# Altium schematic sheet 0218_GPU GDDR6 CHANNELS.SchDoc
size 848 x 558 mm
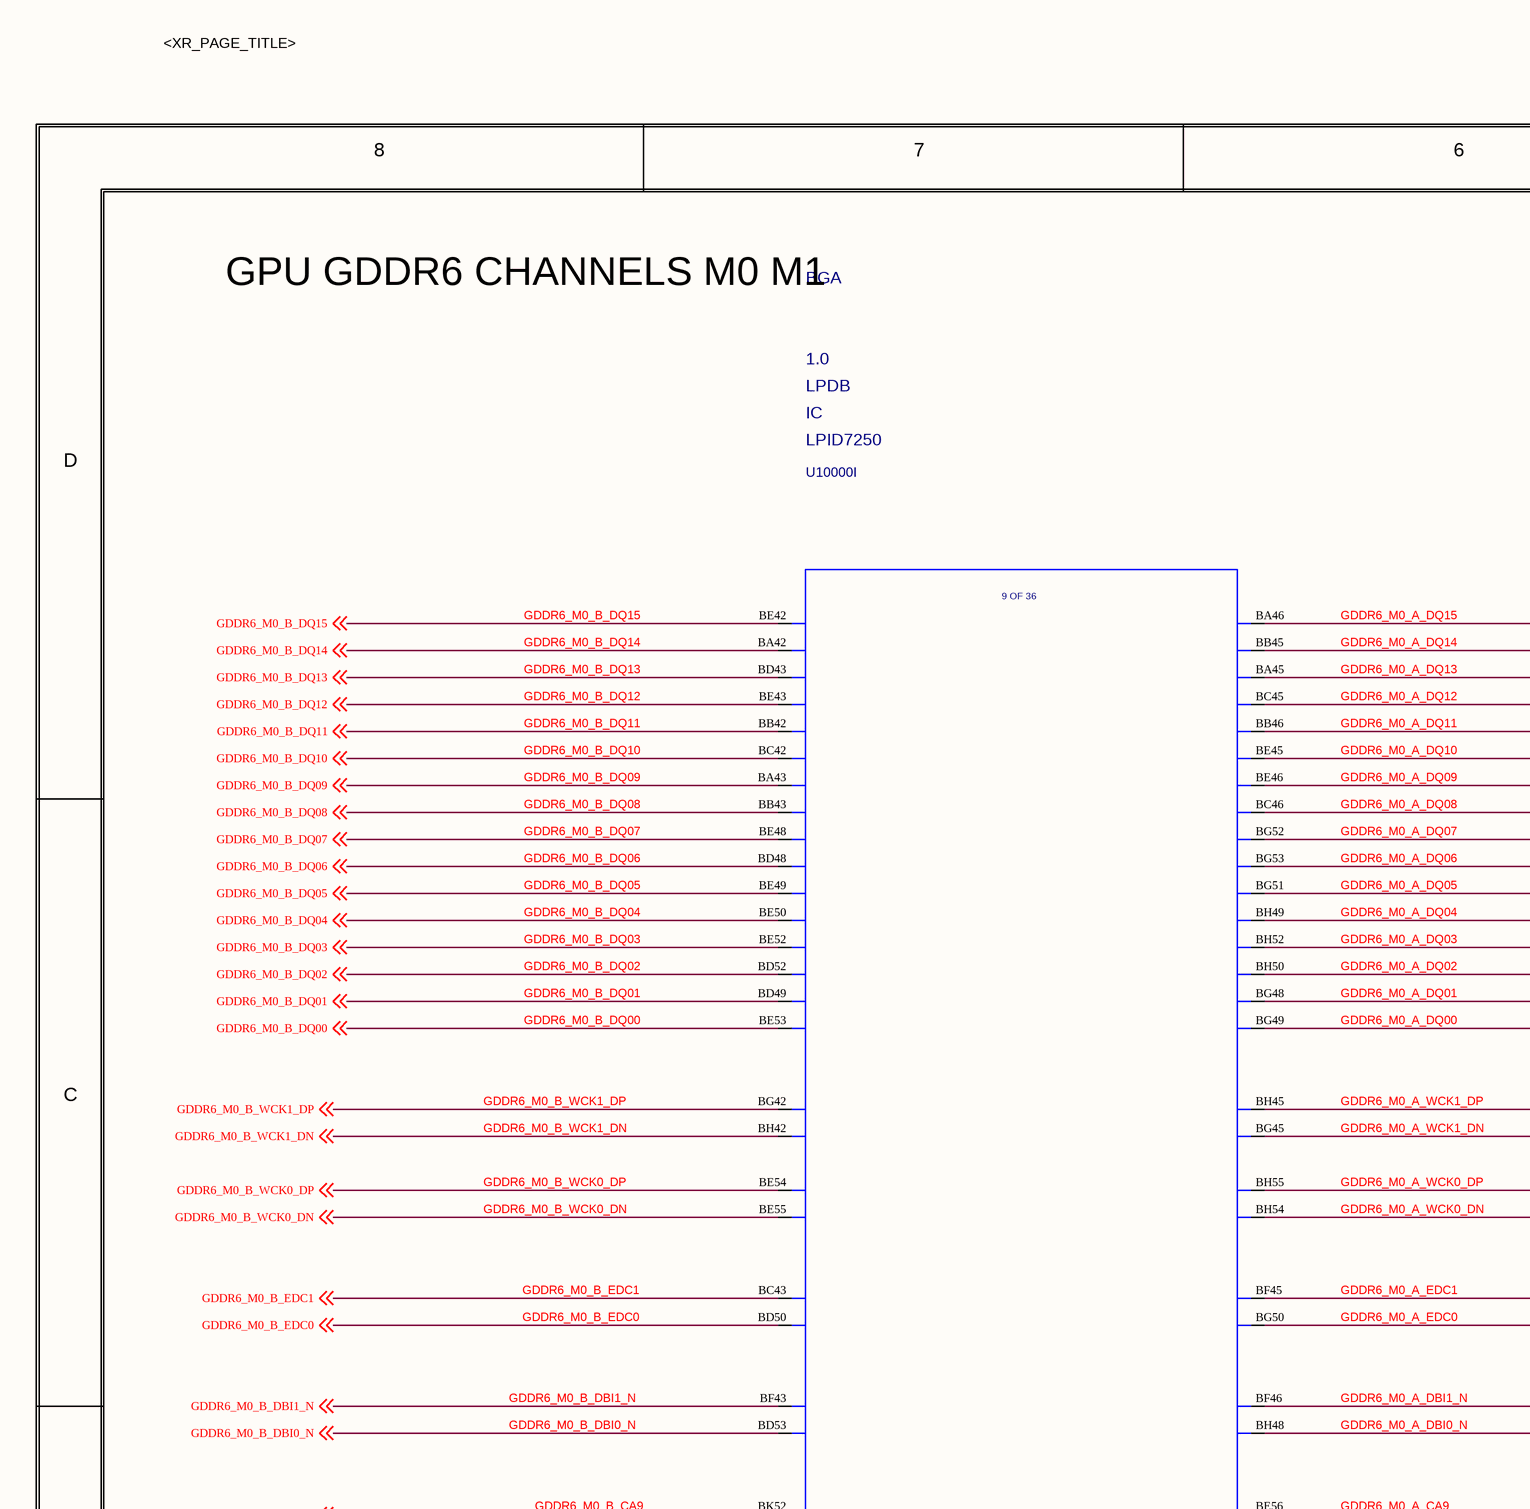
[diagram p0: 0218_GPU GDDR6 CHANNELS.SchDoc, top left]
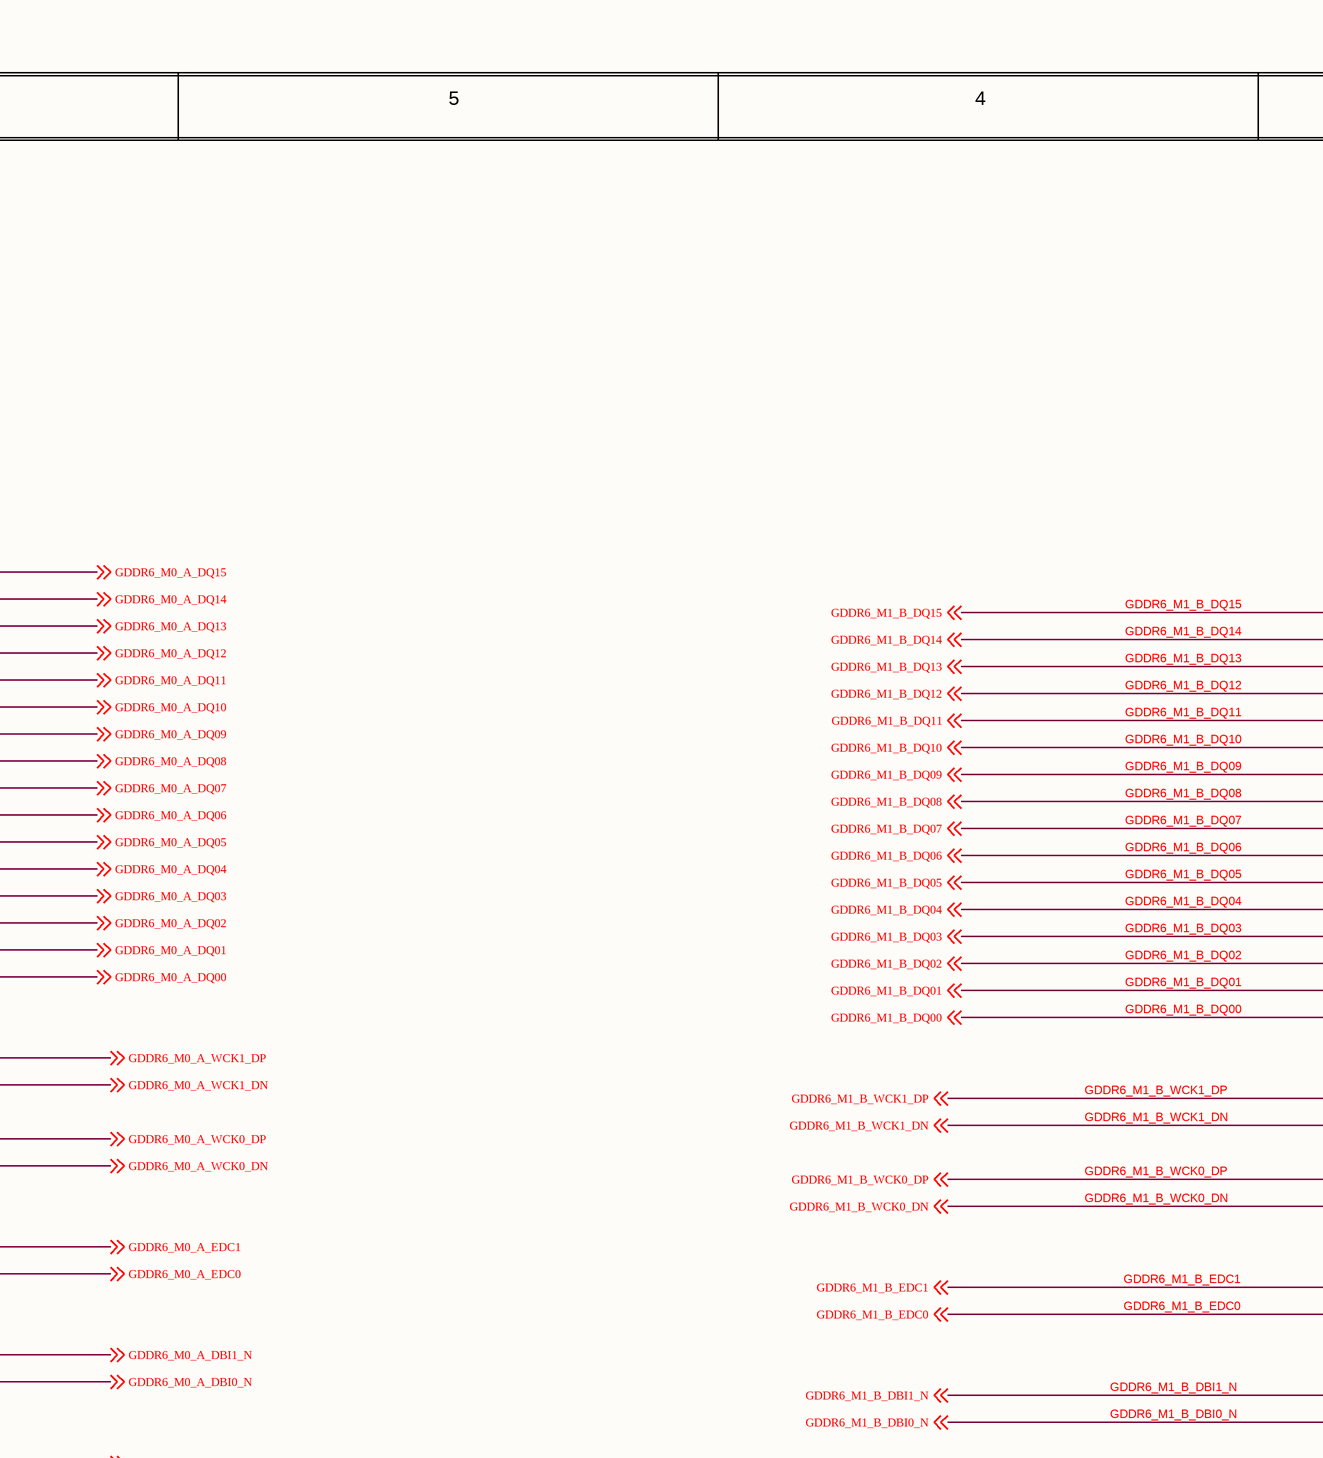
[diagram p1: 0218_GPU GDDR6 CHANNELS.SchDoc, top middle]
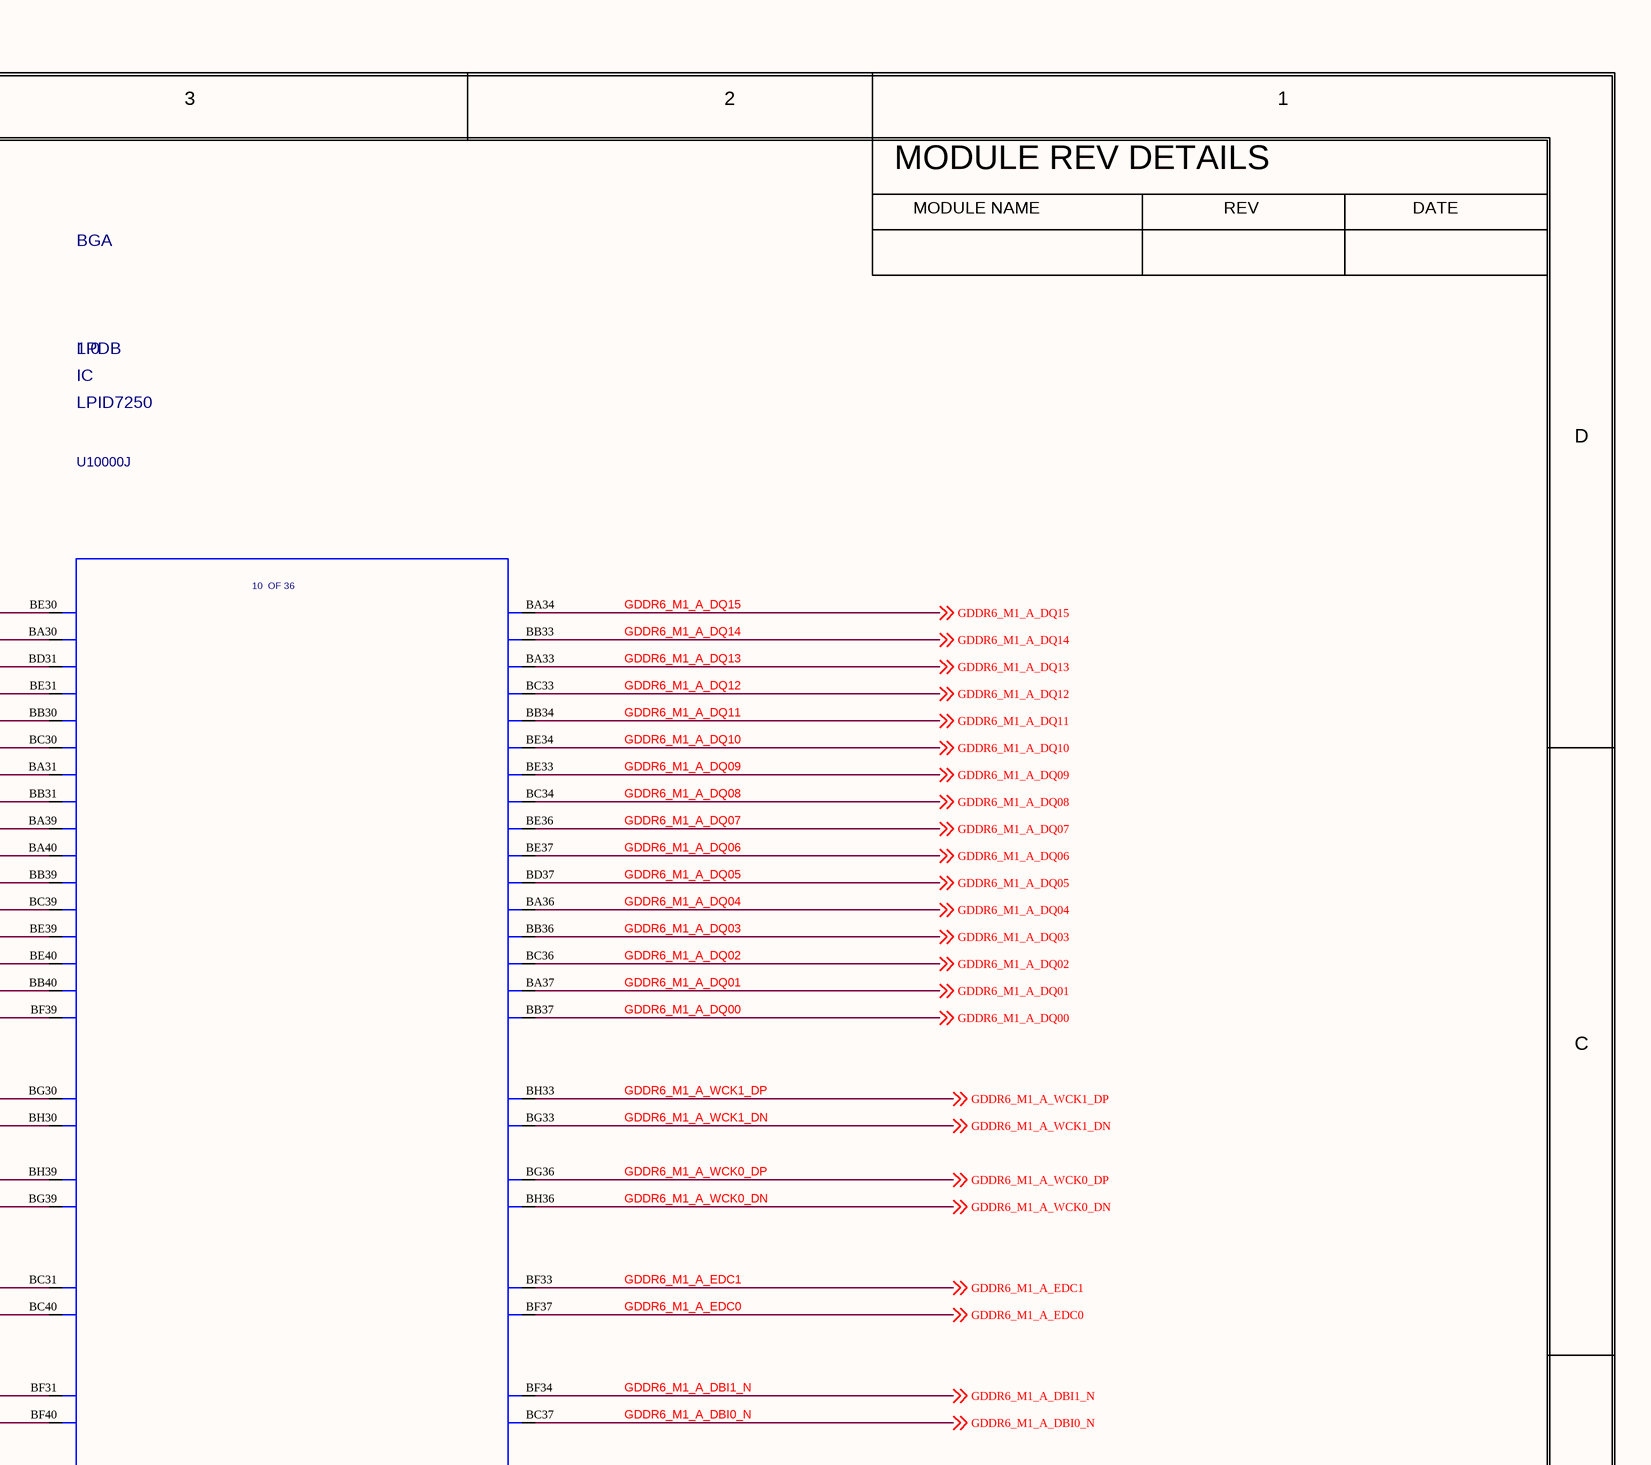
[diagram p2: 0218_GPU GDDR6 CHANNELS.SchDoc, top right]
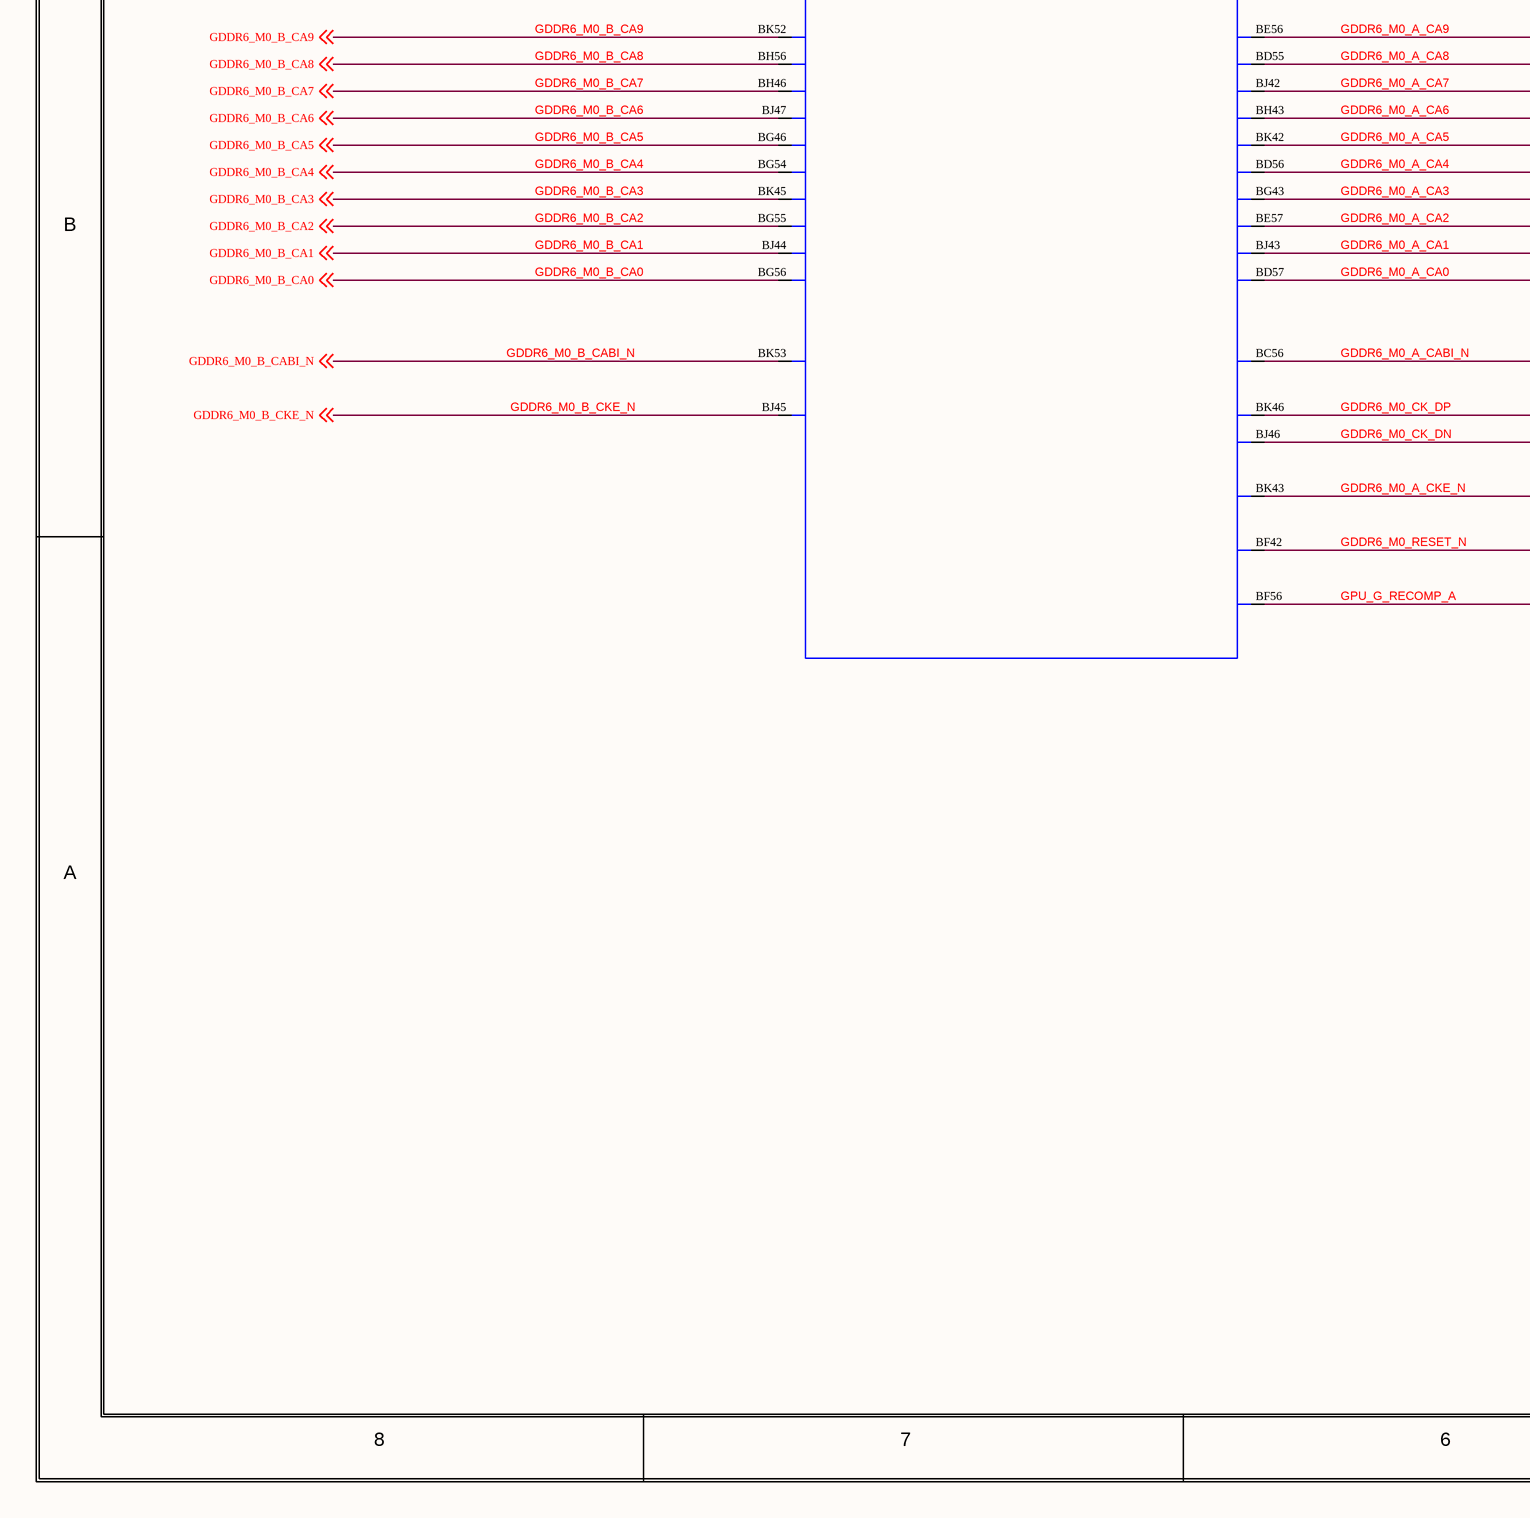
[diagram p3: 0218_GPU GDDR6 CHANNELS.SchDoc, bottom left]
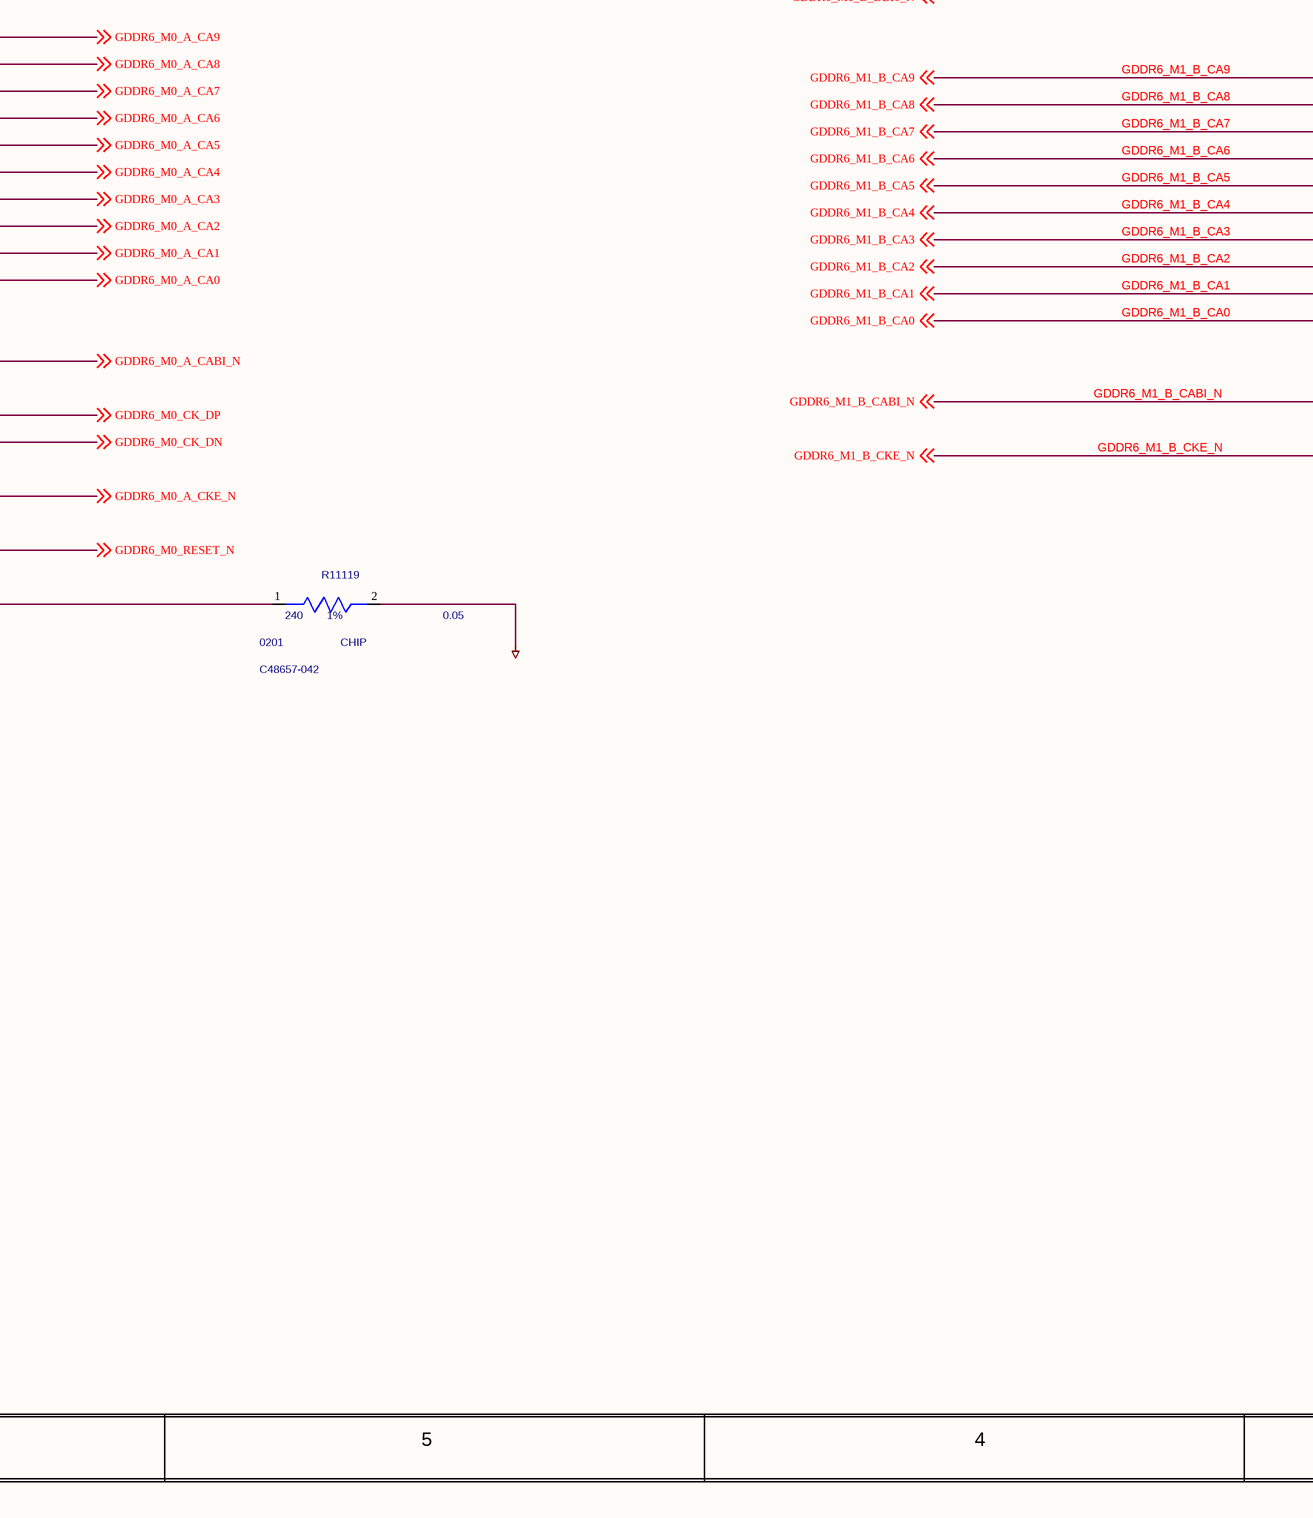
[diagram p4: 0218_GPU GDDR6 CHANNELS.SchDoc, bottom middle]
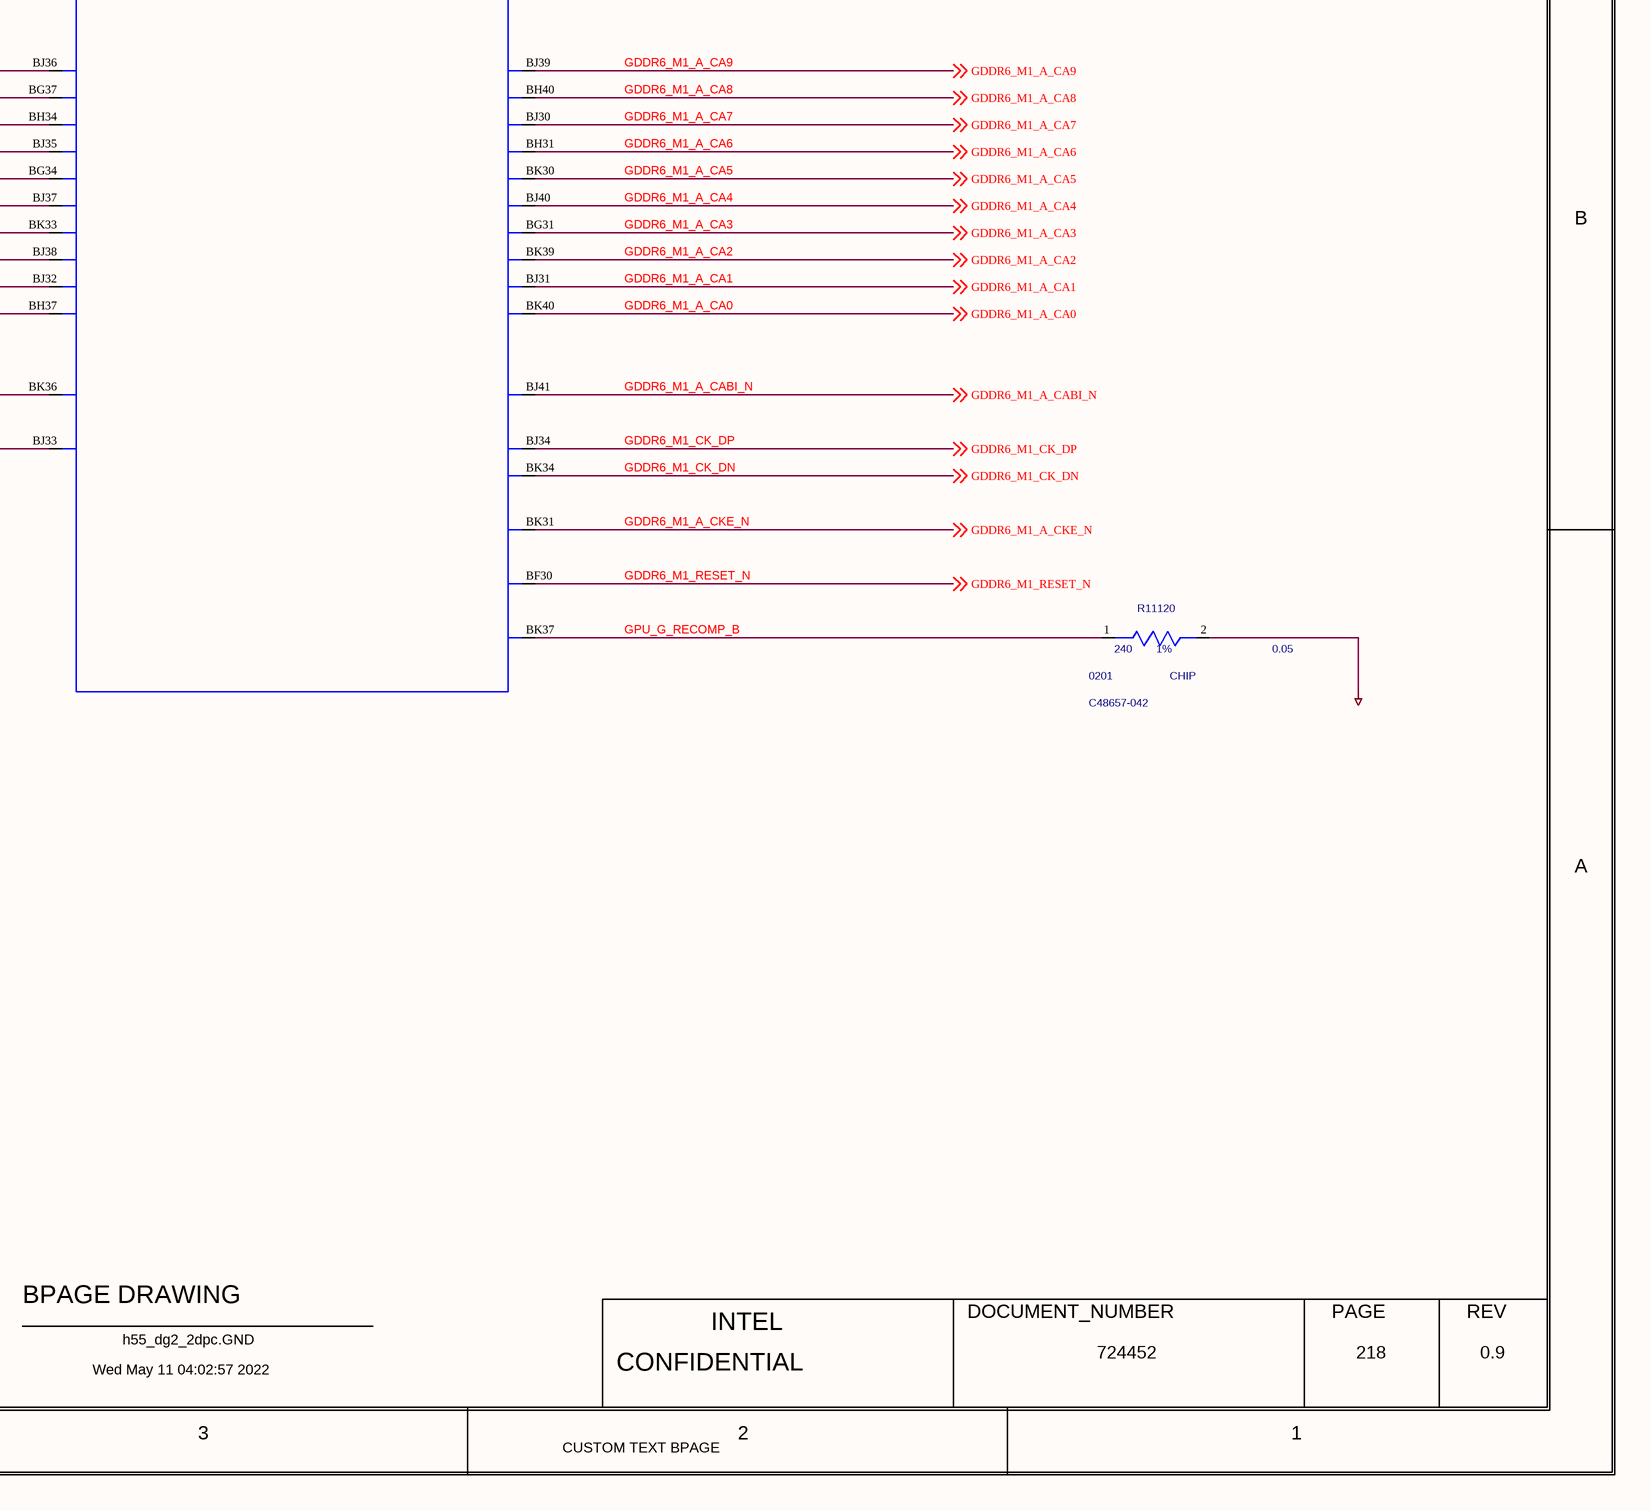
[diagram p5: 0218_GPU GDDR6 CHANNELS.SchDoc, bottom right]

## Parts
R11119  240  MATERIAL: CHIP  PACK_TYPE: 0201  PART_NUMBER: C48657-042  TOLERANCE: 1%  WATTAGE: 0.05  [SMR0201IA]
R11120  240  MATERIAL: CHIP  PACK_TYPE: 0201  PART_NUMBER: C48657-042  TOLERANCE: 1%  WATTAGE: 0.05  [SMR0201IA]
U10000  PART_NUMBER: LPID7250  PACK_TYPE: BGA  MATERIAL: IC  FP_TECH: LPDB  BMAP_REV: 1.0  [CLPDB_BGA2660_DG2_SVC_512_LP7250_MA]  (hidden comment: DG2_IP_NB_SKU1_SKU2_SKU3_EXT)  (parts I,J of 36)

## Nets
GND: R11119.2(B) R11120.2(B)
GDDR6_M0_A_CA0: U10000.BD57(GDDR_C0_A_CA0) ; off-sheet GDDR6_M0_A_CA0
GDDR6_M0_A_CA1: U10000.BJ43(GDDR_C0_A_CA1) ; off-sheet GDDR6_M0_A_CA1
GDDR6_M0_A_CA2: U10000.BE57(GDDR_C0_A_CA2) ; off-sheet GDDR6_M0_A_CA2
GDDR6_M0_A_CA3: U10000.BG43(GDDR_C0_A_CA3) ; off-sheet GDDR6_M0_A_CA3
GDDR6_M0_A_CA4: U10000.BD56(GDDR_C0_A_CA4) ; off-sheet GDDR6_M0_A_CA4
GDDR6_M0_A_CA5: U10000.BK42(GDDR_C0_A_CA5) ; off-sheet GDDR6_M0_A_CA5
GDDR6_M0_A_CA6: U10000.BH43(GDDR_C0_A_CA6) ; off-sheet GDDR6_M0_A_CA6
GDDR6_M0_A_CA7: U10000.BJ42(GDDR_C0_A_CA7) ; off-sheet GDDR6_M0_A_CA7
GDDR6_M0_A_CA8: U10000.BD55(GDDR_C0_A_CA8) ; off-sheet GDDR6_M0_A_CA8
GDDR6_M0_A_CA9: U10000.BE56(GDDR_C0_A_CA9) ; off-sheet GDDR6_M0_A_CA9
GDDR6_M0_A_CABI_N: U10000.BC56(GDDR_C0_A_CABI_N) ; off-sheet GDDR6_M0_A_CABI_N
GDDR6_M0_A_CKE_N: U10000.BK43(GDDR_C0_A_CKE_N) ; off-sheet GDDR6_M0_A_CKE_N
GDDR6_M0_A_DBI0_N: U10000.BH48(GDDR_C0_A_DBI0_N) ; off-sheet GDDR6_M0_A_DBI0_N
GDDR6_M0_A_DBI1_N: U10000.BF46(GDDR_C0_A_DBI1_N) ; off-sheet GDDR6_M0_A_DBI1_N
GDDR6_M0_A_DQ00: U10000.BG49(GDDR_C0_A_DQ0) ; off-sheet GDDR6_M0_A_DQ00
GDDR6_M0_A_DQ01: U10000.BG48(GDDR_C0_A_DQ1) ; off-sheet GDDR6_M0_A_DQ01
GDDR6_M0_A_DQ02: U10000.BH50(GDDR_C0_A_DQ2) ; off-sheet GDDR6_M0_A_DQ02
GDDR6_M0_A_DQ03: U10000.BH52(GDDR_C0_A_DQ3) ; off-sheet GDDR6_M0_A_DQ03
GDDR6_M0_A_DQ04: U10000.BH49(GDDR_C0_A_DQ4) ; off-sheet GDDR6_M0_A_DQ04
GDDR6_M0_A_DQ05: U10000.BG51(GDDR_C0_A_DQ5) ; off-sheet GDDR6_M0_A_DQ05
GDDR6_M0_A_DQ06: U10000.BG53(GDDR_C0_A_DQ6) ; off-sheet GDDR6_M0_A_DQ06
GDDR6_M0_A_DQ07: U10000.BG52(GDDR_C0_A_DQ7) ; off-sheet GDDR6_M0_A_DQ07
GDDR6_M0_A_DQ08: U10000.BC46(GDDR_C0_A_DQ8) ; off-sheet GDDR6_M0_A_DQ08
GDDR6_M0_A_DQ09: U10000.BE46(GDDR_C0_A_DQ9) ; off-sheet GDDR6_M0_A_DQ09
GDDR6_M0_A_DQ10: U10000.BE45(GDDR_C0_A_DQ10) ; off-sheet GDDR6_M0_A_DQ10
GDDR6_M0_A_DQ11: U10000.BB46(GDDR_C0_A_DQ11) ; off-sheet GDDR6_M0_A_DQ11
GDDR6_M0_A_DQ12: U10000.BC45(GDDR_C0_A_DQ12) ; off-sheet GDDR6_M0_A_DQ12
GDDR6_M0_A_DQ13: U10000.BA45(GDDR_C0_A_DQ13) ; off-sheet GDDR6_M0_A_DQ13
GDDR6_M0_A_DQ14: U10000.BB45(GDDR_C0_A_DQ14) ; off-sheet GDDR6_M0_A_DQ14
GDDR6_M0_A_DQ15: U10000.BA46(GDDR_C0_A_DQ15) ; off-sheet GDDR6_M0_A_DQ15
GDDR6_M0_A_EDC0: U10000.BG50(GDDR_C0_A_EDC0) ; off-sheet GDDR6_M0_A_EDC0
GDDR6_M0_A_EDC1: U10000.BF45(GDDR_C0_A_EDC1) ; off-sheet GDDR6_M0_A_EDC1
GDDR6_M0_A_WCK0_DN: U10000.BH54(GDDR_C0_A_WCK0_DN) ; off-sheet GDDR6_M0_A_WCK0_DN
GDDR6_M0_A_WCK0_DP: U10000.BH55(GDDR_C0_A_WCK0_DP) ; off-sheet GDDR6_M0_A_WCK0_DP
GDDR6_M0_A_WCK1_DN: U10000.BG45(GDDR_C0_A_WCK1_DN) ; off-sheet GDDR6_M0_A_WCK1_DN
GDDR6_M0_A_WCK1_DP: U10000.BH45(GDDR_C0_A_WCK1_DP) ; off-sheet GDDR6_M0_A_WCK1_DP
GDDR6_M0_B_CA0: U10000.BG56(GDDR_C0_B_CA0) ; off-sheet GDDR6_M0_B_CA0
GDDR6_M0_B_CA1: U10000.BJ44(GDDR_C0_B_CA1) ; off-sheet GDDR6_M0_B_CA1
GDDR6_M0_B_CA2: U10000.BG55(GDDR_C0_B_CA2) ; off-sheet GDDR6_M0_B_CA2
GDDR6_M0_B_CA3: U10000.BK45(GDDR_C0_B_CA3) ; off-sheet GDDR6_M0_B_CA3
GDDR6_M0_B_CA4: U10000.BG54(GDDR_C0_B_CA4) ; off-sheet GDDR6_M0_B_CA4
GDDR6_M0_B_CA5: U10000.BG46(GDDR_C0_B_CA5) ; off-sheet GDDR6_M0_B_CA5
GDDR6_M0_B_CA6: U10000.BJ47(GDDR_C0_B_CA6) ; off-sheet GDDR6_M0_B_CA6
GDDR6_M0_B_CA7: U10000.BH46(GDDR_C0_B_CA7) ; off-sheet GDDR6_M0_B_CA7
GDDR6_M0_B_CA8: U10000.BH56(GDDR_C0_B_CA8) ; off-sheet GDDR6_M0_B_CA8
GDDR6_M0_B_CA9: U10000.BK52(GDDR_C0_B_CA9) ; off-sheet GDDR6_M0_B_CA9
GDDR6_M0_B_CABI_N: U10000.BK53(GDDR_C0_B_CABI_N) ; off-sheet GDDR6_M0_B_CABI_N
GDDR6_M0_B_CKE_N: U10000.BJ45(GDDR_C0_B_CKE_N) ; off-sheet GDDR6_M0_B_CKE_N
GDDR6_M0_B_DBI0_N: U10000.BD53(GDDR_C0_B_DBI0_N) ; off-sheet GDDR6_M0_B_DBI0_N
GDDR6_M0_B_DBI1_N: U10000.BF43(GDDR_C0_B_DBI1_N) ; off-sheet GDDR6_M0_B_DBI1_N
GDDR6_M0_B_DQ00: U10000.BE53(GDDR_C0_B_DQ0) ; off-sheet GDDR6_M0_B_DQ00
GDDR6_M0_B_DQ01: U10000.BD49(GDDR_C0_B_DQ1) ; off-sheet GDDR6_M0_B_DQ01
GDDR6_M0_B_DQ02: U10000.BD52(GDDR_C0_B_DQ2) ; off-sheet GDDR6_M0_B_DQ02
GDDR6_M0_B_DQ03: U10000.BE52(GDDR_C0_B_DQ3) ; off-sheet GDDR6_M0_B_DQ03
GDDR6_M0_B_DQ04: U10000.BE50(GDDR_C0_B_DQ4) ; off-sheet GDDR6_M0_B_DQ04
GDDR6_M0_B_DQ05: U10000.BE49(GDDR_C0_B_DQ5) ; off-sheet GDDR6_M0_B_DQ05
GDDR6_M0_B_DQ06: U10000.BD48(GDDR_C0_B_DQ6) ; off-sheet GDDR6_M0_B_DQ06
GDDR6_M0_B_DQ07: U10000.BE48(GDDR_C0_B_DQ7) ; off-sheet GDDR6_M0_B_DQ07
GDDR6_M0_B_DQ08: U10000.BB43(GDDR_C0_B_DQ8) ; off-sheet GDDR6_M0_B_DQ08
GDDR6_M0_B_DQ09: U10000.BA43(GDDR_C0_B_DQ9) ; off-sheet GDDR6_M0_B_DQ09
GDDR6_M0_B_DQ10: U10000.BC42(GDDR_C0_B_DQ10) ; off-sheet GDDR6_M0_B_DQ10
GDDR6_M0_B_DQ11: U10000.BB42(GDDR_C0_B_DQ11) ; off-sheet GDDR6_M0_B_DQ11
GDDR6_M0_B_DQ12: U10000.BE43(GDDR_C0_B_DQ12) ; off-sheet GDDR6_M0_B_DQ12
GDDR6_M0_B_DQ13: U10000.BD43(GDDR_C0_B_DQ13) ; off-sheet GDDR6_M0_B_DQ13
GDDR6_M0_B_DQ14: U10000.BA42(GDDR_C0_B_DQ14) ; off-sheet GDDR6_M0_B_DQ14
GDDR6_M0_B_DQ15: U10000.BE42(GDDR_C0_B_DQ15) ; off-sheet GDDR6_M0_B_DQ15
GDDR6_M0_B_EDC0: U10000.BD50(GDDR_C0_B_EDC0) ; off-sheet GDDR6_M0_B_EDC0
GDDR6_M0_B_EDC1: U10000.BC43(GDDR_C0_B_EDC1) ; off-sheet GDDR6_M0_B_EDC1
GDDR6_M0_B_WCK0_DN: U10000.BE55(GDDR_C0_B_WCK0_DN) ; off-sheet GDDR6_M0_B_WCK0_DN
GDDR6_M0_B_WCK0_DP: U10000.BE54(GDDR_C0_B_WCK0_DP) ; off-sheet GDDR6_M0_B_WCK0_DP
GDDR6_M0_B_WCK1_DN: U10000.BH42(GDDR_C0_B_WCK1_DN) ; off-sheet GDDR6_M0_B_WCK1_DN
GDDR6_M0_B_WCK1_DP: U10000.BG42(GDDR_C0_B_WCK1_DP) ; off-sheet GDDR6_M0_B_WCK1_DP
GDDR6_M0_CK_DN: U10000.BJ46(GDDR_C0_CK_DN) ; off-sheet GDDR6_M0_CK_DN
GDDR6_M0_CK_DP: U10000.BK46(GDDR_C0_CK_DP) ; off-sheet GDDR6_M0_CK_DP
GDDR6_M0_RESET_N: U10000.BF42(GDDR_C0_RESET_N) ; off-sheet GDDR6_M0_RESET_N
GDDR6_M1_A_CA0: U10000.BK40(GDDR_C1_A_CA0) ; off-sheet GDDR6_M1_A_CA0
GDDR6_M1_A_CA1: U10000.BJ31(GDDR_C1_A_CA1) ; off-sheet GDDR6_M1_A_CA1
GDDR6_M1_A_CA2: U10000.BK39(GDDR_C1_A_CA2) ; off-sheet GDDR6_M1_A_CA2
GDDR6_M1_A_CA3: U10000.BG31(GDDR_C1_A_CA3) ; off-sheet GDDR6_M1_A_CA3
GDDR6_M1_A_CA4: U10000.BJ40(GDDR_C1_A_CA4) ; off-sheet GDDR6_M1_A_CA4
GDDR6_M1_A_CA5: U10000.BK30(GDDR_C1_A_CA5) ; off-sheet GDDR6_M1_A_CA5
GDDR6_M1_A_CA6: U10000.BH31(GDDR_C1_A_CA6) ; off-sheet GDDR6_M1_A_CA6
GDDR6_M1_A_CA7: U10000.BJ30(GDDR_C1_A_CA7) ; off-sheet GDDR6_M1_A_CA7
GDDR6_M1_A_CA8: U10000.BH40(GDDR_C1_A_CA8) ; off-sheet GDDR6_M1_A_CA8
GDDR6_M1_A_CA9: U10000.BJ39(GDDR_C1_A_CA9) ; off-sheet GDDR6_M1_A_CA9
GDDR6_M1_A_CABI_N: U10000.BJ41(GDDR_C1_A_CABI_N) ; off-sheet GDDR6_M1_A_CABI_N
GDDR6_M1_A_CKE_N: U10000.BK31(GDDR_C1_A_CKE_N) ; off-sheet GDDR6_M1_A_CKE_N
GDDR6_M1_A_DBI0_N: U10000.BC37(GDDR_C1_A_DBI0_N) ; off-sheet GDDR6_M1_A_DBI0_N
GDDR6_M1_A_DBI1_N: U10000.BF34(GDDR_C1_A_DBI1_N) ; off-sheet GDDR6_M1_A_DBI1_N
GDDR6_M1_A_DQ00: U10000.BB37(GDDR_C1_A_DQ0) ; off-sheet GDDR6_M1_A_DQ00
GDDR6_M1_A_DQ01: U10000.BA37(GDDR_C1_A_DQ1) ; off-sheet GDDR6_M1_A_DQ01
GDDR6_M1_A_DQ02: U10000.BC36(GDDR_C1_A_DQ2) ; off-sheet GDDR6_M1_A_DQ02
GDDR6_M1_A_DQ03: U10000.BB36(GDDR_C1_A_DQ3) ; off-sheet GDDR6_M1_A_DQ03
GDDR6_M1_A_DQ04: U10000.BA36(GDDR_C1_A_DQ4) ; off-sheet GDDR6_M1_A_DQ04
GDDR6_M1_A_DQ05: U10000.BD37(GDDR_C1_A_DQ5) ; off-sheet GDDR6_M1_A_DQ05
GDDR6_M1_A_DQ06: U10000.BE37(GDDR_C1_A_DQ6) ; off-sheet GDDR6_M1_A_DQ06
GDDR6_M1_A_DQ07: U10000.BE36(GDDR_C1_A_DQ7) ; off-sheet GDDR6_M1_A_DQ07
GDDR6_M1_A_DQ08: U10000.BC34(GDDR_C1_A_DQ8) ; off-sheet GDDR6_M1_A_DQ08
GDDR6_M1_A_DQ09: U10000.BE33(GDDR_C1_A_DQ9) ; off-sheet GDDR6_M1_A_DQ09
GDDR6_M1_A_DQ10: U10000.BE34(GDDR_C1_A_DQ10) ; off-sheet GDDR6_M1_A_DQ10
GDDR6_M1_A_DQ11: U10000.BB34(GDDR_C1_A_DQ11) ; off-sheet GDDR6_M1_A_DQ11
GDDR6_M1_A_DQ12: U10000.BC33(GDDR_C1_A_DQ12) ; off-sheet GDDR6_M1_A_DQ12
GDDR6_M1_A_DQ13: U10000.BA33(GDDR_C1_A_DQ13) ; off-sheet GDDR6_M1_A_DQ13
GDDR6_M1_A_DQ14: U10000.BB33(GDDR_C1_A_DQ14) ; off-sheet GDDR6_M1_A_DQ14
GDDR6_M1_A_DQ15: U10000.BA34(GDDR_C1_A_DQ15) ; off-sheet GDDR6_M1_A_DQ15
GDDR6_M1_A_EDC0: U10000.BF37(GDDR_C1_A_EDC0) ; off-sheet GDDR6_M1_A_EDC0
GDDR6_M1_A_EDC1: U10000.BF33(GDDR_C1_A_EDC1) ; off-sheet GDDR6_M1_A_EDC1
GDDR6_M1_A_WCK0_DN: U10000.BH36(GDDR_C1_A_WCK0_DN) ; off-sheet GDDR6_M1_A_WCK0_DN
GDDR6_M1_A_WCK0_DP: U10000.BG36(GDDR_C1_A_WCK0_DP) ; off-sheet GDDR6_M1_A_WCK0_DP
GDDR6_M1_A_WCK1_DN: U10000.BG33(GDDR_C1_A_WCK1_DN) ; off-sheet GDDR6_M1_A_WCK1_DN
GDDR6_M1_A_WCK1_DP: U10000.BH33(GDDR_C1_A_WCK1_DP) ; off-sheet GDDR6_M1_A_WCK1_DP
GDDR6_M1_B_CA0: U10000.BH37(GDDR_C1_B_CA0) ; off-sheet GDDR6_M1_B_CA0
GDDR6_M1_B_CA1: U10000.BJ32(GDDR_C1_B_CA1) ; off-sheet GDDR6_M1_B_CA1
GDDR6_M1_B_CA2: U10000.BJ38(GDDR_C1_B_CA2) ; off-sheet GDDR6_M1_B_CA2
GDDR6_M1_B_CA3: U10000.BK33(GDDR_C1_B_CA3) ; off-sheet GDDR6_M1_B_CA3
GDDR6_M1_B_CA4: U10000.BJ37(GDDR_C1_B_CA4) ; off-sheet GDDR6_M1_B_CA4
GDDR6_M1_B_CA5: U10000.BG34(GDDR_C1_B_CA5) ; off-sheet GDDR6_M1_B_CA5
GDDR6_M1_B_CA6: U10000.BJ35(GDDR_C1_B_CA6) ; off-sheet GDDR6_M1_B_CA6
GDDR6_M1_B_CA7: U10000.BH34(GDDR_C1_B_CA7) ; off-sheet GDDR6_M1_B_CA7
GDDR6_M1_B_CA8: U10000.BG37(GDDR_C1_B_CA8) ; off-sheet GDDR6_M1_B_CA8
GDDR6_M1_B_CA9: U10000.BJ36(GDDR_C1_B_CA9) ; off-sheet GDDR6_M1_B_CA9
GDDR6_M1_B_CABI_N: U10000.BK36(GDDR_C1_B_CABI_N) ; off-sheet GDDR6_M1_B_CABI_N
GDDR6_M1_B_CKE_N: U10000.BJ33(GDDR_C1_B_CKE_N) ; off-sheet GDDR6_M1_B_CKE_N
GDDR6_M1_B_DBI0_N: U10000.BF40(GDDR_C1_B_DBI0_N) ; off-sheet GDDR6_M1_B_DBI0_N
GDDR6_M1_B_DBI1_N: U10000.BF31(GDDR_C1_B_DBI1_N) ; off-sheet GDDR6_M1_B_DBI1_N
GDDR6_M1_B_DQ00: U10000.BF39(GDDR_C1_B_DQ0) ; off-sheet GDDR6_M1_B_DQ00
GDDR6_M1_B_DQ01: U10000.BB40(GDDR_C1_B_DQ1) ; off-sheet GDDR6_M1_B_DQ01
GDDR6_M1_B_DQ02: U10000.BE40(GDDR_C1_B_DQ2) ; off-sheet GDDR6_M1_B_DQ02
GDDR6_M1_B_DQ03: U10000.BE39(GDDR_C1_B_DQ3) ; off-sheet GDDR6_M1_B_DQ03
GDDR6_M1_B_DQ04: U10000.BC39(GDDR_C1_B_DQ4) ; off-sheet GDDR6_M1_B_DQ04
GDDR6_M1_B_DQ05: U10000.BB39(GDDR_C1_B_DQ5) ; off-sheet GDDR6_M1_B_DQ05
GDDR6_M1_B_DQ06: U10000.BA40(GDDR_C1_B_DQ6) ; off-sheet GDDR6_M1_B_DQ06
GDDR6_M1_B_DQ07: U10000.BA39(GDDR_C1_B_DQ7) ; off-sheet GDDR6_M1_B_DQ07
GDDR6_M1_B_DQ08: U10000.BB31(GDDR_C1_B_DQ8) ; off-sheet GDDR6_M1_B_DQ08
GDDR6_M1_B_DQ09: U10000.BA31(GDDR_C1_B_DQ9) ; off-sheet GDDR6_M1_B_DQ09
GDDR6_M1_B_DQ10: U10000.BC30(GDDR_C1_B_DQ10) ; off-sheet GDDR6_M1_B_DQ10
GDDR6_M1_B_DQ11: U10000.BB30(GDDR_C1_B_DQ11) ; off-sheet GDDR6_M1_B_DQ11
GDDR6_M1_B_DQ12: U10000.BE31(GDDR_C1_B_DQ12) ; off-sheet GDDR6_M1_B_DQ12
GDDR6_M1_B_DQ13: U10000.BD31(GDDR_C1_B_DQ13) ; off-sheet GDDR6_M1_B_DQ13
GDDR6_M1_B_DQ14: U10000.BA30(GDDR_C1_B_DQ14) ; off-sheet GDDR6_M1_B_DQ14
GDDR6_M1_B_DQ15: U10000.BE30(GDDR_C1_B_DQ15) ; off-sheet GDDR6_M1_B_DQ15
GDDR6_M1_B_EDC0: U10000.BC40(GDDR_C1_B_EDC0) ; off-sheet GDDR6_M1_B_EDC0
GDDR6_M1_B_EDC1: U10000.BC31(GDDR_C1_B_EDC1) ; off-sheet GDDR6_M1_B_EDC1
GDDR6_M1_B_WCK0_DN: U10000.BG39(GDDR_C1_B_WCK0_DN) ; off-sheet GDDR6_M1_B_WCK0_DN
GDDR6_M1_B_WCK0_DP: U10000.BH39(GDDR_C1_B_WCK0_DP) ; off-sheet GDDR6_M1_B_WCK0_DP
GDDR6_M1_B_WCK1_DN: U10000.BH30(GDDR_C1_B_WCK1_DN) ; off-sheet GDDR6_M1_B_WCK1_DN
GDDR6_M1_B_WCK1_DP: U10000.BG30(GDDR_C1_B_WCK1_DP) ; off-sheet GDDR6_M1_B_WCK1_DP
GDDR6_M1_CK_DN: U10000.BK34(GDDR_C1_CK_DN) ; off-sheet GDDR6_M1_CK_DN
GDDR6_M1_CK_DP: U10000.BJ34(GDDR_C1_CK_DP) ; off-sheet GDDR6_M1_CK_DP
GDDR6_M1_RESET_N: U10000.BF30(GDDR_C1_RESET_N) ; off-sheet GDDR6_M1_RESET_N
GPU_G_RECOMP_A: R11119.1(A) U10000.BF56(GDDR_RCOMP_A)
GPU_G_RECOMP_B: R11120.1(A) U10000.BK37(GDDR_RCOMP_B)

## Notes on the sheet
- <XR_PAGE_TITLE>
- 8
- 7
- 6
- 5
- 4
- 3
- 2
- 1
- MODULE REV DETAILS
- GPU GDDR6 CHANNELS M0 M1
- MODULE NAME
- REV
- DATE
- D
- C
- B
- A
- BPAGE DRAWING
- INTEL
- DOCUMENT_NUMBER
- PAGE
- Wed May 11 04:02:57 2022
- h55_dg2_2dpc.GND
- CONFIDENTIAL
- 724452
- 218
- 0.9
- CUSTOM TEXT BPAGE
- (in symbol DG2_IP_NB_SKU1_SKU2_SKU3_EXT, part I) 9 OF 36
- (in symbol DG2_IP_NB_SKU1_SKU2_SKU3_EXT, part J) 10  OF 36

## Library data of the parts
R11119 = RES#1: CHIPS_PART_NAME: RES; CDS_PHYS_PART_NAME: RES_0201-C48657-042,CHIP,240,1%,0.05,LPDB,GENERIC; OriginalSymbolOrigin: (-75,25); XY: (3300,-2050); VER: 1; ROT: 0; PHYS_PAGE: 218; LOCATION: R11119; FP_TECH: LPDB; DRAWING: @RVP1_ADL_SB_ADP_S_DDR5_SODIMM_2DPC_LIB.H55_DG2_2DPC(SCH_1):PAGE389; CDS_LIB: discrete; PCB Footprint: SMR0201IA; CDS_PART_NAME: RES_0201-C48657-042,CHIP,240,1%,0.05,LPDB,GENERIC; CDS_LOCATION: R11119
R11120 = RES#1: CHIPS_PART_NAME: RES; CDS_PHYS_PART_NAME: RES_0201-C48657-042,CHIP,240,1%,0.05,LPDB,GENERIC; OriginalSymbolOrigin: (-75,25); XY: (7275,-2125); VER: 1; ROT: 0; PHYS_PAGE: 218; LOCATION: R11120; FP_TECH: LPDB; DRAWING: @RVP1_ADL_SB_ADP_S_DDR5_SODIMM_2DPC_LIB.H55_DG2_2DPC(SCH_1):PAGE389; CDS_LIB: discrete; PCB Footprint: SMR0201IA; CDS_PART_NAME: RES_0201-C48657-042,CHIP,240,1%,0.05,LPDB,GENERIC; CDS_LOCATION: R11120
U10000 = DG2_IP_NB_SKU1_SKU2_SKU3_EXT: MANUF: INTEL CORP; CDS_PHYS_PART_NAME: DG2_IP_NB_SKU1_SKU2_SKU3_EXT_BGA-LPID7250,IC,DG2_IP_NB_SKU1_SKUA; CDS_LMAN_SYM_OUTLINE: -300,850,300,-800; OriginalSymbolOrigin: (-325,850); CaptureCellPackProp: DG2_IP_NB_SKU1_SKU2_SKU3_EXTI; XY: (1700,-700); VER: 9; ROT: 0; PHYS_PAGE: 218; MFG_PN: NONE; LOCATION: U10000; DRAWING: @RVP1_ADL_SB_ADP_S_DDR5_SODIMM_2DPC_LIB.H55_DG2_2DPC(SCH_1):PAGE389; CDS_LIB: rvp1_adl_sb_adp_s_ddr5_sodimm_2dpc_lib; PCB Footprint: CLPDB_BGA2660_DG2_SVC_512_LP7250_MA; SEC_TYPE: BGA; CHIPS_PART_NAME: DG2_IP_NB_SKU1_SKU2_SKU3_EXT; CDS_PART_NAME: DG2_IP_NB_SKU1_SKU2_SKU3_EXT_BGA-LPID7250,IC,DG2_IP_NB_SKU1_SKUA; CDS_LOCATION: U10000